# EasyEDA Pro project ProProject_IMUSensorNodes202312.epro, board 6_6_拼板20240123（带编号） (continued)
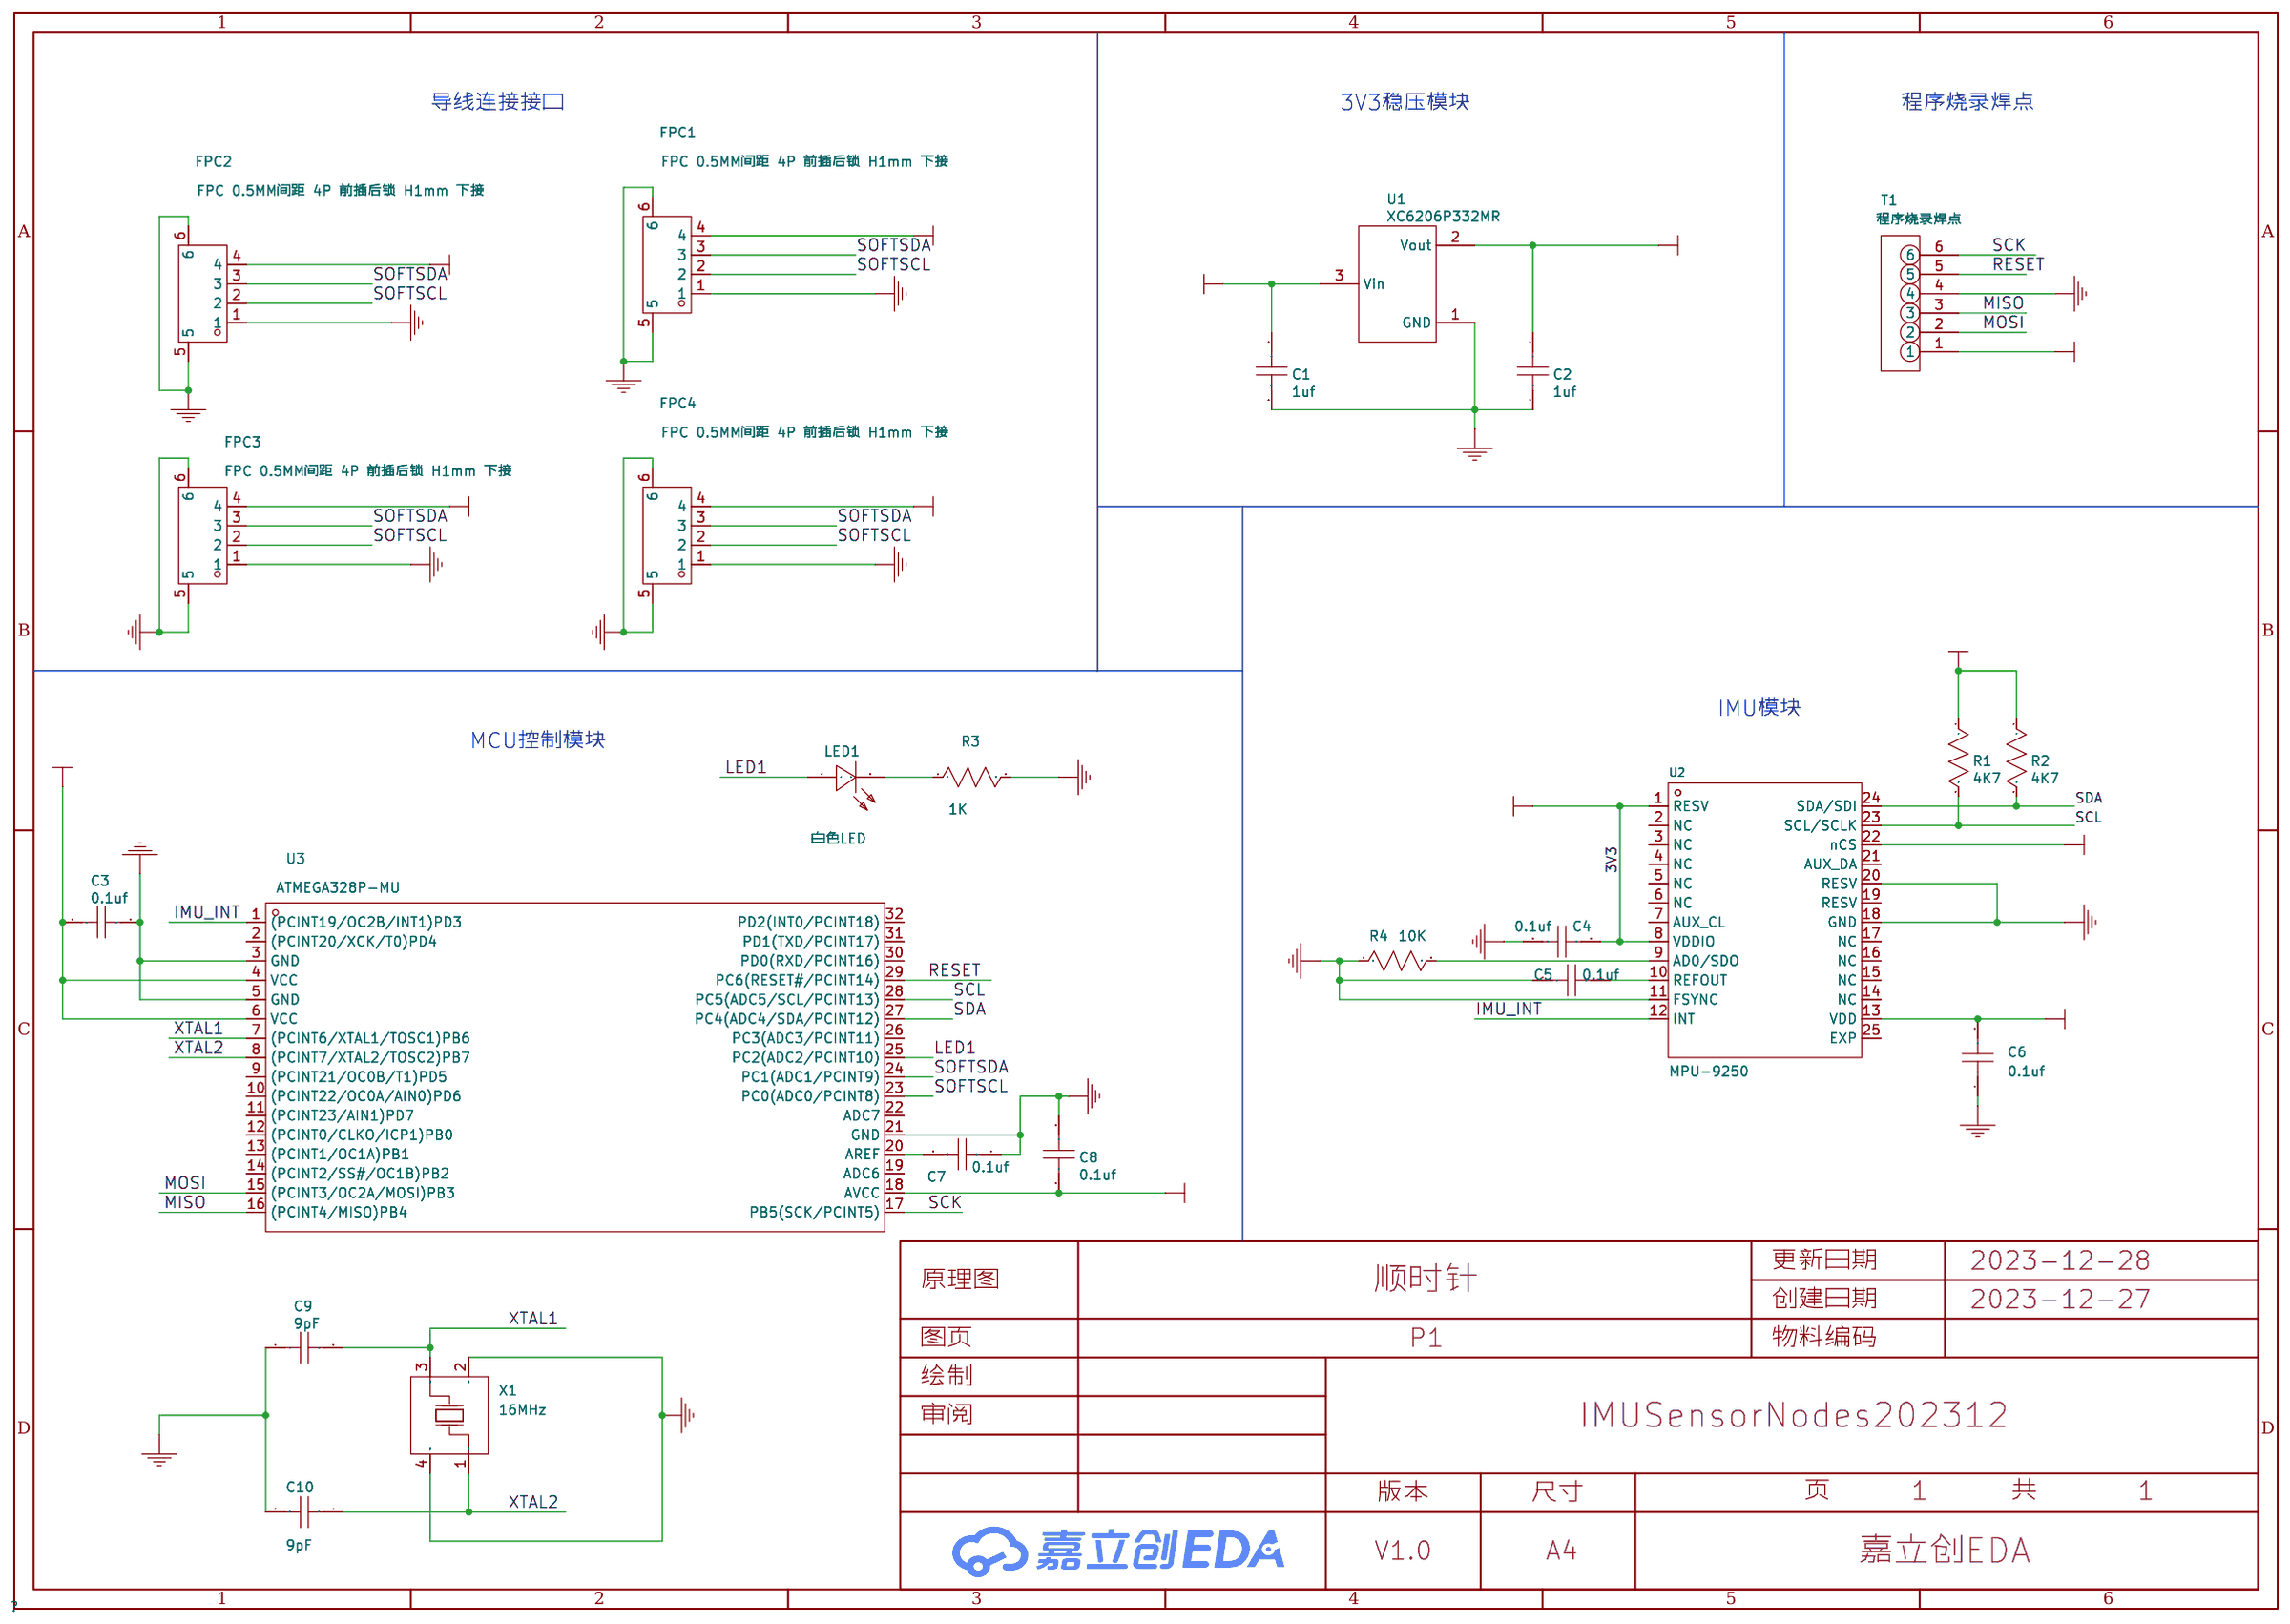
[diagram p0: schematic sheet]
## Nets (continued)
SDA: Designator#313.27 Designator#314.24 Designator#317.24 Designator#318.24 Designator#319.24 Designator#321.27 Designator#322.27 Designator#323.24 Designator#324.27 Designator#325.27 Designator#326.24 Designator#329.2 Designator#332.2 Designator#335.2 Designator#338.2 Designator#341.2 Designator#344.2 Designator#347.2 Designator#350.2 Designator#353.2 Designator#356.2 Designator#359.2 Designator#362.2 Designator#364.2 Designator#367.2 Designator#370.2 Designator#373.2 Designator#376.2 Designator#379.2 Designator#382.2 Designator#385.2 Designator#388.2 Designator#391.2 Designator#394.2 Designator#397.2 Designator#400.2 Designator#403.2 Designator#406.2 Designator#409.2 Designator#412.2 Designator#415.2 Designator#418.2 Designator#421.2 Designator#424.2 Designator#427.2 Designator#430.2 Designator#433.2 Designator#437.24 Designator#438.24 Designator#440.27 Designator#801.27 Designator#803.27 Designator#806.27 Designator#808.27 Designator#809.27 Designator#810.27 Designator#811.27 Designator#813.24 Designator#814.24 Designator#818.24 Designator#819.24 Designator#820.27 Designator#822.27 Designator#826.24 Designator#827.27 Designator#829.27 Designator#830.24 Designator#831.24 Designator#832.27 Designator#835.27 Designator#836.24 Designator#837.27 Designator#838.27 Designator#839.27 Designator#877.24 Designator#878.24 Designator#880.24 Designator#881.24 Designator#882.24 Designator#883.24 Designator#885.27 Designator#886.24 Designator#888.24 Designator#889.27 Designator#890.24 Designator#892.27 Designator#895.27 Designator#896.27 Designator#897.24 Designator#900.24 Designator#901.24 Designator#902.27 Designator#903.27 Designator#904.27 Designator#906.27 Designator#909.24 Designator#910.27 Designator#911.24 Designator#912.24 Designator#913.27 Designator#915.24 Designator#916.27 Designator#917.27 Designator#918.24 Designator#919.24 Designator#920.27 Designator#921.24 Designator#923.24
SOFTSCL: Designator.2 Designator#2.3 Designator#3.2 Designator#4.3 Designator#5.2 Designator#6.2 Designator#7.2 Designator#8.2 Designator#9.3 Designator#10.2 Designator#11.2 Designator#12.3 Designator#13.3 Designator#14.2 Designator#15.2 Designator#16.2 Designator#17.3 Designator#18.2 Designator#19.3 Designator#20.3 Designator#81.3 Designator#82.3 Designator#83.3 Designator#84.3 Designator#85.2 Designator#86.2 Designator#87.3 Designator#88.2 Designator#89.3 Designator#90.3 Designator#91.3 Designator#92.2 Designator#93.2 Designator#94.2 Designator#95.3 Designator#96.2 Designator#97.3 Designator#98.2 Designator#99.2 Designator#100.3 Designator#101.2 Designator#102.3 Designator#103.3 Designator#104.3 Designator#105.2 Designator#106.3 Designator#107.2 Designator#108.3 Designator#109.3 Designator#146.3 Designator#147.3 Designator#148.2 Designator#149.3 Designator#150.2 Designator#151.2 Designator#152.3 Designator#153.3 Designator#154.3 Designator#155.3 Designator#156.2 Designator#157.2 Designator#158.3 Designator#159.2 Designator#160.3 Designator#161.2 Designator#162.3 Designator#163.2 Designator#164.3 Designator#165.3 Designator#166.2 Designator#167.3 Designator#168.3 Designator#169.2 Designator#170.3 Designator#171.3 Designator#172.3 Designator#173.3 Designator#174.3 Designator#175.2 Designator#176.3 Designator#177.3 Designator#214.2 Designator#215.2 Designator#216.3 Designator#217.2 Designator#218.2 Designator#219.2 Designator#220.3 Designator#221.2 Designator#222.2 Designator#223.2 Designator#224.2 Designator#225.2 Designator#226.3 Designator#227.3 Designator#228.3 Designator#229.3 Designator#230.2 Designator#231.2 Designator#232.3 Designator#233.2 Designator#234.2 Designator#235.3 Designator#236.2 Designator#237.2 Designator#238.2 Designator#239.2 Designator#240.2 Designator#241.3 Designator#242.3 Designator#243.2 Designator#244.3 Designator#245.3 Designator#282.3 Designator#283.2 Designator#284.3 Designator#285.3 Designator#286.3 Designator#287.3 Designator#288.3 Designator#289.3 Designator#290.2 Designator#291.2 Designator#292.2 Designator#293.2 Designator#294.2 Designator#295.3 Designator#296.3 Designator#297.2 Designator#298.2 Designator#299.2 Designator#300.2 Designator#301.2 Designator#302.2 Designator#303.2 Designator#304.3 Designator#305.3 Designator#306.3 Designator#307.3 Designator#308.2 Designator#309.2 Designator#310.3 Designator#311.2 Designator#312.2 Designator#313.23 Designator#321.23 Designator#322.23 Designator#324.23 Designator#325.23 Designator#440.23 Designator#801.23 Designator#803.23 Designator#806.23 Designator#808.23 Designator#809.23 Designator#810.23 Designator#811.23 Designator#820.23 Designator#822.23 Designator#827.23 Designator#829.23 Designator#832.23 Designator#835.23 Designator#837.23 Designator#838.23 Designator#839.23 Designator#885.23 Designator#889.23 Designator#892.23 Designator#895.23 Designator#896.23 Designator#902.23 Designator#903.23 Designator#904.23 Designator#906.23 Designator#910.23 Designator#913.23 Designator#916.23 Designator#917.23 Designator#920.23
SOFTSDA: Designator.3 Designator#2.2 Designator#3.3 Designator#4.2 Designator#5.3 Designator#6.3 Designator#7.3 Designator#8.3 Designator#9.2 Designator#10.3 Designator#11.3 Designator#12.2 Designator#13.2 Designator#14.3 Designator#15.3 Designator#16.3 Designator#17.2 Designator#18.3 Designator#19.2 Designator#20.2 Designator#81.2 Designator#82.2 Designator#83.2 Designator#84.2 Designator#85.3 Designator#86.3 Designator#87.2 Designator#88.3 Designator#89.2 Designator#90.2 Designator#91.2 Designator#92.3 Designator#93.3 Designator#94.3 Designator#95.2 Designator#96.3 Designator#97.2 Designator#98.3 Designator#99.3 Designator#100.2 Designator#101.3 Designator#102.2 Designator#103.2 Designator#104.2 Designator#105.3 Designator#106.2 Designator#107.3 Designator#108.2 Designator#109.2 Designator#146.2 Designator#147.2 Designator#148.3 Designator#149.2 Designator#150.3 Designator#151.3 Designator#152.2 Designator#153.2 Designator#154.2 Designator#155.2 Designator#156.3 Designator#157.3 Designator#158.2 Designator#159.3 Designator#160.2 Designator#161.3 Designator#162.2 Designator#163.3 Designator#164.2 Designator#165.2 Designator#166.3 Designator#167.2 Designator#168.2 Designator#169.3 Designator#170.2 Designator#171.2 Designator#172.2 Designator#173.2 Designator#174.2 Designator#175.3 Designator#176.2 Designator#177.2 Designator#214.3 Designator#215.3 Designator#216.2 Designator#217.3 Designator#218.3 Designator#219.3 Designator#220.2 Designator#221.3 Designator#222.3 Designator#223.3 Designator#224.3 Designator#225.3 Designator#226.2 Designator#227.2 Designator#228.2 Designator#229.2 Designator#230.3 Designator#231.3 Designator#232.2 Designator#233.3 Designator#234.3 Designator#235.2 Designator#236.3 Designator#237.3 Designator#238.3 Designator#239.3 Designator#240.3 Designator#241.2 Designator#242.2 Designator#243.3 Designator#244.2 Designator#245.2 Designator#282.2 Designator#283.3 Designator#284.2 Designator#285.2 Designator#286.2 Designator#287.2 Designator#288.2 Designator#289.2 Designator#290.3 Designator#291.3 Designator#292.3 Designator#293.3 Designator#294.3 Designator#295.2 Designator#296.2 Designator#297.3 Designator#298.3 Designator#299.3 Designator#300.3 Designator#301.3 Designator#302.3 Designator#303.3 Designator#304.2 Designator#305.2 Designator#306.2 Designator#307.2 Designator#308.3 Designator#309.3 Designator#310.2 Designator#311.3 Designator#312.3 Designator#313.24 Designator#321.24 Designator#322.24 Designator#324.24 Designator#325.24 Designator#440.24 Designator#801.24 Designator#803.24 Designator#806.24 Designator#808.24 Designator#809.24 Designator#810.24 Designator#811.24 Designator#820.24 Designator#822.24 Designator#827.24 Designator#829.24 Designator#832.24 Designator#835.24 Designator#837.24 Designator#838.24 Designator#839.24 Designator#885.24 Designator#889.24 Designator#892.24 Designator#895.24 Designator#896.24 Designator#902.24 Designator#903.24 Designator#904.24 Designator#906.24 Designator#910.24 Designator#913.24 Designator#916.24 Designator#917.24 Designator#920.24
XTAL1: Designator#110.3 Designator#111.3 Designator#112.3 Designator#113.3 Designator#114.3 Designator#115.3 Designator#116.3 Designator#117.3 Designator#118.3 Designator#119.3 Designator#120.3 Designator#121.3 Designator#122.3 Designator#123.3 Designator#124.3 Designator#125.3 Designator#126.3 Designator#127.3 Designator#128.3 Designator#129.3 Designator#130.3 Designator#131.3 Designator#132.3 Designator#133.3 Designator#134.3 Designator#135.3 Designator#136.3 Designator#137.3 Designator#138.3 Designator#139.3 Designator#140.3 Designator#141.3 Designator#142.3 Designator#143.3 Designator#144.3 Designator#145.3 Designator#313.7 Designator#321.7 Designator#322.7 Designator#324.7 Designator#325.7 Designator#440.7 Designator#442.2 Designator#444.2 Designator#449.2 Designator#459.2 Designator#469.2 Designator#479.2 Designator#489.2 Designator#499.2 Designator#509.2 Designator#519.2 Designator#529.2 Designator#539.2 Designator#550.2 Designator#573.2 Designator#583.2 Designator#593.2 Designator#603.2 Designator#613.2 Designator#623.2 Designator#633.2 Designator#648.2 Designator#650.2 Designator#662.2 Designator#672.2 Designator#682.2 Designator#692.2 Designator#702.2 Designator#712.2 Designator#722.2 Designator#732.2 Designator#742.2 Designator#752.2 Designator#762.2 Designator#772.2 Designator#782.2 Designator#792.2 Designator#801.7 Designator#803.7 Designator#806.7 Designator#808.7 Designator#809.7 Designator#810.7 Designator#811.7 Designator#820.7 Designator#822.7 Designator#827.7 Designator#829.7 Designator#832.7 Designator#835.7 Designator#837.7 Designator#838.7 Designator#839.7 Designator#885.7 Designator#889.7 Designator#892.7 Designator#895.7 Designator#896.7 Designator#902.7 Designator#903.7 Designator#904.7 Designator#906.7 Designator#910.7 Designator#913.7 Designator#916.7 Designator#917.7 Designator#920.7
XTAL2: Designator#110.1 Designator#111.1 Designator#112.1 Designator#113.1 Designator#114.1 Designator#115.1 Designator#116.1 Designator#117.1 Designator#118.1 Designator#119.1 Designator#120.1 Designator#121.1 Designator#122.1 Designator#123.1 Designator#124.1 Designator#125.1 Designator#126.1 Designator#127.1 Designator#128.1 Designator#129.1 Designator#130.1 Designator#131.1 Designator#132.1 Designator#133.1 Designator#134.1 Designator#135.1 Designator#136.1 Designator#137.1 Designator#138.1 Designator#139.1 Designator#140.1 Designator#141.1 Designator#142.1 Designator#143.1 Designator#144.1 Designator#145.1 Designator#313.8 Designator#321.8 Designator#322.8 Designator#324.8 Designator#325.8 Designator#440.8 Designator#441.1 Designator#443.1 Designator#448.1 Designator#458.1 Designator#468.1 Designator#478.1 Designator#488.1 Designator#498.1 Designator#508.1 Designator#518.1 Designator#528.1 Designator#538.1 Designator#549.1 Designator#572.1 Designator#582.1 Designator#592.1 Designator#602.1 Designator#612.1 Designator#622.1 Designator#632.1 Designator#642.1 Designator#649.1 Designator#661.1 Designator#671.1 Designator#681.1 Designator#691.1 Designator#701.1 Designator#711.1 Designator#721.1 Designator#731.1 Designator#741.1 Designator#751.1 Designator#761.1 Designator#771.1 Designator#781.1 Designator#791.1 Designator#801.8 Designator#803.8 Designator#806.8 Designator#808.8 Designator#809.8 Designator#810.8 Designator#811.8 Designator#820.8 Designator#822.8 Designator#827.8 Designator#829.8 Designator#832.8 Designator#835.8 Designator#837.8 Designator#838.8 Designator#839.8 Designator#885.8 Designator#889.8 Designator#892.8 Designator#895.8 Designator#896.8 Designator#902.8 Designator#903.8 Designator#904.8 Designator#906.8 Designator#910.8 Designator#913.8 Designator#916.8 Designator#917.8 Designator#920.8
$1N1083: Designator#179.1 Designator#181.1 Designator#184.1 Designator#186.1 Designator#188.1 Designator#190.1 Designator#192.1 Designator#194.1 Designator#196.1 Designator#197.1 Designator#199.1 Designator#201.1 Designator#203.1 Designator#205.1 Designator#207.1 Designator#209.1 Designator#211.1 Designator#213.1 Designator#247.2 Designator#249.2 Designator#252.2 Designator#254.2 Designator#256.2 Designator#258.2 Designator#260.2 Designator#262.2 Designator#264.2 Designator#265.2 Designator#267.2 Designator#269.2 Designator#271.2 Designator#273.2 Designator#275.2 Designator#277.2 Designator#279.2 Designator#281.2
$1N1108: Designator#313.20 Designator#321.20 Designator#325.20 Designator#440.20 Designator#465.2 Designator#485.2 Designator#515.2 Designator#535.2 Designator#556.2 Designator#569.2 Designator#589.2 Designator#609.2 Designator#629.2 Designator#639.2 Designator#658.2 Designator#678.2 Designator#698.2 Designator#718.2 Designator#738.2 Designator#758.2 Designator#778.2 Designator#798.2 Designator#803.20 Designator#806.20 Designator#808.20 Designator#811.20 Designator#827.20 Designator#829.20 Designator#832.20 Designator#837.20 Designator#892.20 Designator#896.20 Designator#903.20 Designator#916.20 Designator#917.20 Designator#920.20
$1N1134: Designator#178.1 Designator#180.1 Designator#182.1 Designator#183.1 Designator#185.1 Designator#187.1 Designator#189.1 Designator#191.1 Designator#193.1 Designator#195.1 Designator#198.1 Designator#200.1 Designator#202.1 Designator#204.1 Designator#206.1 Designator#208.1 Designator#210.1 Designator#212.1 Designator#246.2 Designator#248.2 Designator#250.2 Designator#251.2 Designator#253.2 Designator#255.2 Designator#257.2 Designator#259.2 Designator#261.2 Designator#263.2 Designator#266.2 Designator#268.2 Designator#270.2 Designator#272.2 Designator#274.2 Designator#276.2 Designator#278.2 Designator#280.2
$1N1156: Designator#322.20 Designator#324.20 Designator#455.2 Designator#475.2 Designator#495.2 Designator#505.2 Designator#525.2 Designator#545.2 Designator#564.2 Designator#579.2 Designator#599.2 Designator#619.2 Designator#645.2 Designator#668.2 Designator#688.2 Designator#708.2 Designator#728.2 Designator#748.2 Designator#768.2 Designator#788.2 Designator#801.20 Designator#809.20 Designator#810.20 Designator#820.20 Designator#822.20 Designator#835.20 Designator#838.20 Designator#839.20 Designator#885.20 Designator#889.20 Designator#895.20 Designator#902.20 Designator#904.20 Designator#906.20 Designator#910.20 Designator#913.20
$1N1216: Designator#314.9 Designator#323.9 Designator#326.9 Designator#328.2 Designator#331.2 Designator#337.2 Designator#343.2 Designator#346.2 Designator#352.2 Designator#358.2 Designator#369.2 Designator#375.2 Designator#381.2 Designator#390.2 Designator#396.2 Designator#402.2 Designator#408.2 Designator#414.2 Designator#420.2 Designator#426.2 Designator#432.2 Designator#813.9 Designator#826.9 Designator#830.9 Designator#836.9 Designator#880.9 Designator#881.9 Designator#882.9 Designator#883.9 Designator#886.9 Designator#890.9 Designator#897.9 Designator#912.9 Designator#915.9 Designator#918.9 Designator#923.9
$1N1217: Designator#314.10 Designator#323.10 Designator#326.10 Designator#446.2 Designator#461.2 Designator#481.2 Designator#501.2 Designator#511.2 Designator#531.2 Designator#552.2 Designator#585.2 Designator#605.2 Designator#625.2 Designator#652.2 Designator#674.2 Designator#694.2 Designator#714.2 Designator#734.2 Designator#754.2 Designator#774.2 Designator#794.2 Designator#813.10 Designator#826.10 Designator#830.10 Designator#836.10 Designator#880.10 Designator#881.10 Designator#882.10 Designator#883.10 Designator#886.10 Designator#890.10 Designator#897.10 Designator#912.10 Designator#915.10 Designator#918.10 Designator#923.10
$1N1698: Designator#317.9 Designator#318.9 Designator#319.9 Designator#334.2 Designator#340.2 Designator#349.2 Designator#355.2 Designator#361.2 Designator#366.2 Designator#372.2 Designator#378.2 Designator#384.2 Designator#387.2 Designator#393.2 Designator#399.2 Designator#405.2 Designator#411.2 Designator#417.2 Designator#423.2 Designator#429.2 Designator#435.2 Designator#437.9 Designator#438.9 Designator#814.9 Designator#818.9 Designator#819.9 Designator#831.9 Designator#877.9 Designator#878.9 Designator#888.9 Designator#900.9 Designator#901.9 Designator#909.9 Designator#911.9 Designator#919.9 Designator#921.9
$1N1725: Designator#317.10 Designator#318.10 Designator#319.10 Designator#437.10 Designator#438.10 Designator#451.2 Designator#471.2 Designator#491.2 Designator#521.2 Designator#541.2 Designator#560.2 Designator#575.2 Designator#595.2 Designator#615.2 Designator#635.2 Designator#654.2 Designator#664.2 Designator#684.2 Designator#704.2 Designator#724.2 Designator#744.2 Designator#764.2 Designator#784.2 Designator#814.10 Designator#818.10 Designator#819.10 Designator#831.10 Designator#877.10 Designator#878.10 Designator#888.10 Designator#900.10 Designator#901.10 Designator#909.10 Designator#911.10 Designator#919.10 Designator#921.10

Pads without a net: Designator#21 1 2 3 4 5 6 7 8 9 10 11 12 13 14 15 16; Designator#22 1 2 3 4 5 6 7 8 9 10 11 12 13 14 15 16; Designator#23 1 2 3 4 5 6 7 8 9 10 11 12 13 14 15 16; Designator#24 1 2 3 4 5 6 7 8 9 10 11 12 13 14 15 16; Designator#25 1 2 3 4 5 6 7 8 9 10 11 12 13 14 15 16; Designator#26 1 2 3 4 5 6 7 8 9 10 11 12 13 14 15 16; Designator#27 1 2 3 4 5 6 7 8 9 10 11 12 13 14 15 16; Designator#28 1 2 3 4 5 6 7 8 9 10 11 12 13 14 15 16; Designator#29 1 2 3 4 5 6 7 8 9 10 11 12 13 14 15 16; Designator#30 1 2 3 4 5 6 7 8 9 10 11 12 13 14 15 16; Designator#31 1 2 3 4 5 6 7 8 9 10 11 12 13 14 15 16; Designator#32 1 2 3 4 5 6 7 8 9 10 11 12 13 14 15 16; Designator#33 1 2 3 4 5 6 7 8 9 10 11 12 13 14 15 16; Designator#34 1 2 3 4 5 6 7 8 9 10 11 12 13 14 15 16; Designator#35 1 2 3 4 5 6 7 8 9 10 11 12 13 14 15 16; Designator#36 1 2 3 4 5 6 7 8 9 10 11 12 13 14 15 16; Designator#37 1 2 3 4 5 6 7 8 9 10 11 12 13 14 15 16; Designator#38 1 2 3 4 5 6 7 8 9 10 11 12 13 14 15 16; Designator#39 1 2 3 4 5 6 7 8 9 10 11 12 13 14 15 16; Designator#40 1 2 3 4 5 6 7 8 9 10 11 12 13 14 15 16; Designator#41 1 2 3 4 5 6 7 8 9 10 11 12 13 14 15 16; Designator#42 1 2 3 4 5 6 7 8 9 10 11 12 13 14 15 16; Designator#43 1 2 3 4 5 6 7 8 9 10 11 12 13 14 15 16; Designator#44 1 2 3 4 5 6 7 8 9 10 11 12 13 14 15 16; Designator#45 1 2 3 4 5 6 7 8 9 10 11 12 13 14 15 16; Designator#46 1 2 3 4 5 6 7 8 9 10 11 12 13 14 15 16; Designator#47 1 2 3 4 5 6 7 8 9 10 11 12 13 14 15 16; Designator#48 1 2 3 4 5 6 7 8 9 10 11 12 13 14 15 16; Designator#49 1 2 3 4 5 6 7 8 9 10 11 12 13 14 15 16; Designator#50 1 2 3 4 5 6 7 8 9 10 11 12 13 14 15 16; Designator#51 1 2 3 4 5 6 7 8 9 10 11 12 13 14 15 16; Designator#52 1 2 3 4 5 6 7 8 9 10 11 12 13 14 15 16; Designator#53 1 2 3 4 5 6 7 8 9 10 11 12 13 14 15 16; Designator#54 1 2 3 4 5 6 7 8 9 10 11 12 13 14 15 16; Designator#55 1 2 3 4 5 6 7 8 9 10 11 12 13 14 15 16; Designator#56 1 2 3 4 5 6 7 8 9 10 11 12 13 14 15 16; Designator#57 1 2 3 4 5 6 7 8 9 10 11 12 13 14 15 16; Designator#58 1 2 3 4 5 6 7 8 9 10 11 12 13 14 15 16; Designator#59 1 2 3 4 5 6 7 8 9 10 11 12 13 14 15 16; Designator#60 1 2 3 4 5 6 7 8 9 10 11 12 13 14 15 16; Designator#61 1 2 3 4 5 6 7 8 9 10 11 12 13 14 15 16; Designator#62 1 2 3 4 5 6 7 8 9 10 11 12 13 14 15 16; Designator#63 1 2 3 4 5 6 7 8 9 10 11 12 13 14 15 16; Designator#64 1 2 3 4 5 6 7 8 9 10 11 12 13 14 15 16; Designator#65 1 2 3 4 5 6 7 8 9 10 11 12 13 14 15 16; Designator#66 1 2 3 4 5 6 7 8 9 10 11 12 13 14 15 16; Designator#67 1 2 3 4 5 6 7 8 9 10 11 12 13 14 15 16; Designator#68 1 2 3 4 5 6 7 8 9 10 11 12 13 14 15 16; Designator#69 1 2 3 4 5 6 7 8 9 10 11 12 13 14 15 16; Designator#70 1 2 3 4 5 6 7 8 9 10 11 12 13 14 15 16; Designator#71 1 2 3 4 5 6 7 8 9 10 11 12 13 14 15 16; Designator#72 1 2 3 4 5 6 7 8 9 10 11 12 13 14 15 16; Designator#73 1 2 3 4 5 6 7 8 9 10 11 12 13 14 15 16; Designator#74 1 2 3 4 5 6 7 8 9 10 11 12 13 14 15 16; Designator#75 1 2 3 4 5 6 7 8 9 10 11 12 13 14 15 16; Designator#76 1 2 3 4 5 6 7 8 9 10 11 12 13 14 15 16; Designator#77 1 2 3 4 5 6 7 8 9 10 11 12 13 14 15 16; Designator#78 1 2 3 4 5 6 7 8 9 10 11 12 13 14 15 16; Designator#79 1 2 3 4 5 6 7 8 9 10 11 12 13 14 15 16; Designator#80 1 2 3 4 5 6 7 8 9 10 11 12 13 14 15 16; Designator#313 2 10 11 12 13 19 32; Designator#314 2 3 4 5 6 7 14 15 16 17 19 21; Designator#317 2 3 4 5 6 14 15 16 17 19 21; Designator#318 2 3 4 5 6 14 15 16 17 19 21; Designator#319 2 3 4 5 6 14 15 16 17 19 21; Designator#321 2 10 11 12 13 19 32; Designator#322 2 9 10 11 12 14 19 31 32; Designator#323 2 3 4 5 6 7 14 15 16 17 19 21; Designator#324 2 9 10 11 12 14 19 31 32; Designator#325 2 10 11 12 13 19 32; Designator#326 2 3 4 5 6 7 14 15 16 17 19 21; Designator#437 2 3 4 5 6 14 15 16 17 19 21; Designator#438 2 3 4 5 6 14 15 16 17 19 21; Designator#440 2 10 11 12 13 19 32; Designator#801 2 9 10 11 12 14 19 31 32; Designator#803 2 10 11 12 13 19 32; Designator#806 2 10 11 12 13 19 32; Designator#808 2 10 11 12 13 19 32; Designator#809 2 9 10 11 12 14 19 31 32; Designator#810 2 9 10 11 12 14 19 31 32; Designator#811 2 10 11 12 13 19 32; Designator#813 2 3 4 5 6 7 14 15 16 17 19 21; Designator#814 2 3 4 5 6 14 15 16 17 19 21; Designator#818 2 3 4 5 6 14 15 16 17 19 21; Designator#819 2 3 4 5 6 14 15 16 17 19 21; Designator#820 2 9 10 11 12 14 19 31 32; Designator#822 2 9 10 11 12 14 19 31 32; Designator#826 2 3 4 5 6 7 14 15 16 17 19 21; Designator#827 2 10 11 12 13 19 32; Designator#829 2 10 11 12 13 19 32; Designator#830 2 3 4 5 6 7 14 15 16 17 19 21; Designator#831 2 3 4 5 6 14 15 16 17 19 21; Designator#832 2 10 11 12 13 19 32; Designator#835 2 9 10 11 12 14 19 31 32; Designator#836 2 3 4 5 6 7 14 15 16 17 19 21; Designator#837 2 10 11 12 13 19 32; Designator#838 2 9 10 11 12 14 19 31 32; Designator#839 2 9 10 11 12 14 19 31 32; Designator#877 2 3 4 5 6 14 15 16 17 19 21; Designator#878 2 3 4 5 6 14 15 16 17 19 21; Designator#880 2 3 4 5 6 7 14 15 16 17 19 21; Designator#881 2 3 4 5 6 7 14 15 16 17 19 21; Designator#882 2 3 4 5 6 7 14 15 16 17 19 21; Designator#883 2 3 4 5 6 7 14 15 16 17 19 21; Designator#885 2 9 10 11 12 14 19 31 32; Designator#886 2 3 4 5 6 7 14 15 16 17 19 21; Designator#888 2 3 4 5 6 14 15 16 17 19 21; Designator#889 2 9 10 11 12 14 19 31 32; Designator#890 2 3 4 5 6 7 14 15 16 17 19 21; Designator#892 2 10 11 12 13 19 32; Designator#895 2 9 10 11 12 14 19 31 32; Designator#896 2 10 11 12 13 19 32; Designator#897 2 3 4 5 6 7 14 15 16 17 19 21; Designator#900 2 3 4 5 6 14 15 16 17 19 21; Designator#901 2 3 4 5 6 14 15 16 17 19 21; Designator#902 2 9 10 11 12 14 19 31 32; Designator#903 2 10 11 12 13 19 32; Designator#904 2 9 10 11 12 14 19 31 32; Designator#906 2 9 10 11 12 14 19 31 32; Designator#909 2 3 4 5 6 14 15 16 17 19 21; Designator#910 2 9 10 11 12 14 19 31 32; Designator#911 2 3 4 5 6 14 15 16 17 19 21; Designator#912 2 3 4 5 6 7 14 15 16 17 19 21; Designator#913 2 9 10 11 12 14 19 31 32; Designator#915 2 3 4 5 6 7 14 15 16 17 19 21; Designator#916 2 10 11 12 13 19 32; Designator#917 2 10 11 12 13 19 32; Designator#918 2 3 4 5 6 7 14 15 16 17 19 21; Designator#919 2 3 4 5 6 14 15 16 17 19 21; Designator#920 2 10 11 12 13 19 32; Designator#921 2 3 4 5 6 14 15 16 17 19 21; Designator#923 2 3 4 5 6 7 14 15 16 17 19 21

## Via types
v1: diameter 0.5, hole 0.3, Top Layer to Bottom Layer, 1188 vias
v2: diameter 0.5, hole 0.299, Top Layer to Bottom Layer, 108 vias

## Routing (per net, layer and track width the routed paths; a pad name or vN(x,y) marks a point on that pad's centre or on a via; arc(x,y) is an arc through that point)
3V3: length 1145
  Top Layer w0.254: v1(20.6,56.04) 22.38,57.81 v1(22.38,58.7) ; v1(76.99,72.42) 76.99,71.53 v1(75.22,69.75) ; v1(43.47,8.92) 42.75,8.92 v1(42.25,9.43) ; v1(57.07,64.07) 56.98,64.16 55.78,64.16 v1(55.66,64.29) 55.53,64.42 v1(55.53,65.56) ; v1(0.92,24.41) 0.92,23.27 v1(1.05,23.14) 1.17,23.02 2.37,23.02 v1(2.46,22.92) ; v1(47.91,14.89) 49.69,16.67 v1(49.69,17.56) ; v1(42.25,36.86) 42.75,36.35 v1(43.47,36.35) ; v1(0.92,65.56) 0.92,64.42 v1(1.05,64.29) 1.17,64.16 2.37,64.16 v1(2.46,64.07) ; v1(69.55,23.14) 70.06,22.64 v1(70.77,22.64) ; v1(20.6,14.89) 22.38,16.67 v1(22.38,17.56) ; v1(28.22,65.56) 28.22,64.42 v1(28.35,64.29) 28.48,64.16 29.68,64.16 v1(29.77,64.07) ; v1(28.22,79.28) 28.22,78.13 v1(28.35,78.01) 28.48,77.88 29.68,77.88 v1(29.77,77.79) ; v1(69.55,78.01) 70.06,77.5 v1(70.77,77.5) ; v1(47.91,56.04) 49.69,57.81 v1(49.69,58.7) ; v1(70.77,8.92) 70.06,8.92 v1(69.55,9.43) ; v1(2.46,50.36) 2.37,50.45 1.17,50.45 v1(1.05,50.58) 0.92,50.7 v1(0.92,51.84) ; v1(55.53,79.28) 55.53,78.13 v1(55.66,78.01) 55.78,77.88 56.98,77.88 v1(57.07,77.79) ; v1(0.92,79.28) 0.92,78.13 v1(1.05,78.01) 1.17,77.88 2.37,77.88 v1(2.46,77.79) ; v1(16.16,77.5) 15.45,77.5 v1(14.94,78.01) ; v1(42.25,78.01) 42.75,77.5 v1(43.47,77.5) ; v1(76.99,44.99) 76.99,44.1 v1(75.22,42.32) ; v1(49.69,72.42) 49.69,71.53 v1(47.91,69.75) ; v1(28.22,24.41) 28.22,23.27 v1(28.35,23.14) 28.48,23.02 29.68,23.02 v1(29.77,22.92) ; v1(29.77,9.21) 29.68,9.3 28.48,9.3 v1(28.35,9.43) 28.22,9.55 v1(28.22,10.7) ; v1(42.25,64.29) 42.75,63.78 v1(43.47,63.78) ; v1(57.07,36.64) 56.98,36.73 55.78,36.73 v1(55.66,36.86) 55.53,36.99 v1(55.53,38.13) ; v1(70.77,63.78) 70.06,63.78 v1(69.55,64.29) ; v1(47.91,1.17) 49.69,2.95 v1(49.69,3.84) ; v1(22.38,44.99) 22.38,44.1 v1(20.6,42.32) ; v1(16.16,8.92) 15.45,8.92 v1(14.94,9.43) ; v1(0.92,38.13) 0.92,36.99 v1(1.05,36.86) 1.17,36.73 2.37,36.73 v1(2.46,36.64) ; v1(70.77,50.07) 70.06,50.07 v1(69.55,50.58) ; v1(43.47,50.07) 42.75,50.07 v1(42.25,50.58) ; v1(29.77,50.36) 29.68,50.45 28.48,50.45 v1(28.35,50.58) 28.22,50.7 v1(28.22,51.84) ; v1(42.25,23.14) 42.75,22.64 v1(43.47,22.64) ; v1(20.6,28.6) 22.38,30.38 v1(22.38,31.27) ; v1(49.69,31.27) 49.69,30.38 v1(47.91,28.6) ; v1(47.91,42.32) 49.69,44.1 v1(49.69,44.99) ; v1(75.22,1.17) 76.99,2.95 v1(76.99,3.84) ; v1(14.94,23.14) 15.45,22.64 v1(16.16,22.64) ; v1(14.94,64.29) 15.45,63.78 v1(16.16,63.78) ; v1(55.53,10.7) 55.53,9.55 v1(55.66,9.43) 55.78,9.3 56.98,9.3 v1(57.07,9.21) ; v1(55.53,51.84) 55.53,50.7 v1(55.66,50.58) 55.78,50.45 56.98,50.45 v1(57.07,50.36) ; v1(75.22,28.6) 76.99,30.38 v1(76.99,31.27) ; v1(76.99,58.7) 76.99,57.81 v1(75.22,56.04) ; v1(57.07,22.92) 56.98,23.02 55.78,23.02 v1(55.66,23.14) 55.53,23.27 v1(55.53,24.41) ; v1(22.38,3.84) 22.38,2.95 v1(20.6,1.17) ; v1(2.46,9.21) 2.37,9.3 1.17,9.3 v1(1.05,9.43) 0.92,9.55 v1(0.92,10.7) ; v1(14.94,50.58) 15.45,50.07 v1(16.16,50.07) ; v1(16.16,36.35) 15.45,36.35 v1(14.94,36.86) ; v1(28.22,38.13) 28.22,36.99 v1(28.35,36.86) 28.48,36.73 29.68,36.73 v1(29.77,36.64) ; v1(69.55,36.86) 70.06,36.35 v1(70.77,36.35) ; v1(76.99,17.56) 76.99,16.67 v1(75.22,14.89) ; v1(22.38,72.42) 22.38,71.53 v1(20.6,69.75)
  Bottom Layer w0.2: 29.11,38.89 30.89,38.89 30.91,38.87 Designator#921.1 ; Designator#814.1 58.21,80.02 58.2,80.04 56.42,80.04 ; 1.81,52.61 3.59,52.61 3.6,52.59 Designator#888.1 ; 1.81,11.46 3.59,11.46 3.6,11.44 Designator#438.1 ; Designator#911.1 58.21,11.44 58.2,11.46 56.42,11.46 ; 1.81,25.17 3.59,25.17 3.6,25.16 Designator#318.1 ; Designator#319.1 30.91,52.59 30.89,52.61 29.11,52.61 ; Designator#437.1 3.6,80.02 3.59,80.04 1.81,80.04 ; 56.42,25.17 58.2,25.17 58.21,25.16 Designator#900.1 ; Designator#909.1 30.91,25.16 30.89,25.17 29.11,25.17 ; 56.42,66.32 58.2,66.32 58.21,66.31 Designator#819.1 ; 56.42,38.89 58.2,38.89 58.21,38.87 Designator#919.1 ; Designator#831.1 30.91,11.44 30.89,11.46 29.11,11.46 ; 29.11,80.04 30.89,80.04 30.91,80.02 Designator#901.1 ; 1.81,38.89 3.59,38.89 3.6,38.87 Designator#317.1 ; 29.11,66.32 30.89,66.32 30.91,66.31 Designator#878.1 ; 56.42,52.61 58.2,52.61 58.21,52.59 Designator#877.1 ; Designator#818.1 3.6,66.31 3.59,66.32 1.81,66.32